# EAGLE board Resistor_Resistor (EAGLE 8.3.0), part 23 of 32
## Placement (x,y rotation side) (continued)
R27970  10K  [0201]  194.82,104.29 0 top
R27971  10K  [0201]  194.82,104.9 0 top
R27972  10K  [0201]  194.82,105.51 0 top
R27973  10K  [0201]  194.82,106.12 0 top
R27974  10K  [0201]  194.82,106.73 0 top
R27975  10K  [0201]  194.82,107.34 0 top
R27976  10K  [0201]  194.82,107.95 0 top
R27977  10K  [0201]  194.82,108.56 0 top
R27978  10K  [0201]  194.82,109.17 0 top
R27979  10K  [0201]  194.82,109.78 0 top
R27980  10K  [0201]  194.82,110.39 0 top
R27981  10K  [0201]  194.82,111 0 top
R27982  10K  [0201]  194.82,111.61 0 top
R27983  10K  [0201]  194.82,112.22 0 top
R27984  10K  [0201]  194.82,112.83 0 top
R27985  10K  [0201]  194.82,113.44 0 top
R27986  10K  [0201]  194.82,114.05 0 top
R27987  10K  [0201]  194.82,114.66 0 top
R27988  10K  [0201]  194.82,115.27 0 top
R27989  10K  [0201]  194.82,115.87 0 top
R27990  10K  [0201]  194.82,116.48 0 top
R27991  10K  [0201]  194.82,117.09 0 top
R27992  10K  [0201]  194.82,117.7 0 top
R27993  10K  [0201]  194.82,118.31 0 top
R27994  10K  [0201]  194.82,118.92 0 top
R27995  10K  [0201]  194.82,119.53 0 top
R27996  10K  [0201]  194.82,120.14 0 top
R27997  10K  [0201]  194.82,120.75 0 top
R27998  10K  [0201]  194.82,121.36 0 top
R27999  10K  [0201]  194.82,121.97 0 top
R28000  10K  [0201]  194.82,122.58 0 top
R28001  10K  [0201]  196.04,1.27 0 top
R28002  10K  [0201]  196.04,1.88 0 top
R28003  10K  [0201]  196.04,2.49 0 top
R28004  10K  [0201]  196.04,3.1 0 top
R28005  10K  [0201]  196.04,3.71 0 top
R28006  10K  [0201]  196.04,4.32 0 top
R28007  10K  [0201]  196.04,4.93 0 top
R28008  10K  [0201]  196.04,5.54 0 top
R28009  10K  [0201]  196.04,6.15 0 top
R28010  10K  [0201]  196.04,6.76 0 top
R28011  10K  [0201]  196.04,7.37 0 top
R28012  10K  [0201]  196.04,7.98 0 top
R28013  10K  [0201]  196.04,8.59 0 top
R28014  10K  [0201]  196.04,9.19 0 top
R28015  10K  [0201]  196.04,9.8 0 top
R28016  10K  [0201]  196.04,10.41 0 top
R28017  10K  [0201]  196.04,11.02 0 top
R28018  10K  [0201]  196.04,11.63 0 top
R28019  10K  [0201]  196.04,12.24 0 top
R28020  10K  [0201]  196.04,12.85 0 top
R28021  10K  [0201]  196.04,13.46 0 top
R28022  10K  [0201]  196.04,14.07 0 top
R28023  10K  [0201]  196.04,14.68 0 top
R28024  10K  [0201]  196.04,15.29 0 top
R28025  10K  [0201]  196.04,15.9 0 top
R28026  10K  [0201]  196.04,16.51 0 top
R28027  10K  [0201]  196.04,17.12 0 top
R28028  10K  [0201]  196.04,17.73 0 top
R28029  10K  [0201]  196.04,18.34 0 top
R28030  10K  [0201]  196.04,18.95 0 top
R28031  10K  [0201]  196.04,19.56 0 top
R28032  10K  [0201]  196.04,20.17 0 top
R28033  10K  [0201]  196.04,20.78 0 top
R28034  10K  [0201]  196.04,21.39 0 top
R28035  10K  [0201]  196.04,22 0 top
R28036  10K  [0201]  196.04,22.61 0 top
R28037  10K  [0201]  196.04,23.22 0 top
R28038  10K  [0201]  196.04,23.83 0 top
R28039  10K  [0201]  196.04,24.43 0 top
R28040  10K  [0201]  196.04,25.04 0 top
R28041  10K  [0201]  196.04,25.65 0 top
R28042  10K  [0201]  196.04,26.26 0 top
R28043  10K  [0201]  196.04,26.87 0 top
R28044  10K  [0201]  196.04,27.48 0 top
R28045  10K  [0201]  196.04,28.09 0 top
R28046  10K  [0201]  196.04,28.7 0 top
R28047  10K  [0201]  196.04,29.31 0 top
R28048  10K  [0201]  196.04,29.92 0 top
R28049  10K  [0201]  196.04,30.53 0 top
R28050  10K  [0201]  196.04,31.14 0 top
R28051  10K  [0201]  196.04,31.75 0 top
R28052  10K  [0201]  196.04,32.36 0 top
R28053  10K  [0201]  196.04,32.97 0 top
R28054  10K  [0201]  196.04,33.58 0 top
R28055  10K  [0201]  196.04,34.19 0 top
R28056  10K  [0201]  196.04,34.8 0 top
R28057  10K  [0201]  196.04,35.41 0 top
R28058  10K  [0201]  196.04,36.02 0 top
R28059  10K  [0201]  196.04,36.63 0 top
R28060  10K  [0201]  196.04,37.24 0 top
R28061  10K  [0201]  196.04,37.85 0 top
R28062  10K  [0201]  196.04,38.46 0 top
R28063  10K  [0201]  196.04,39.07 0 top
R28064  10K  [0201]  196.04,39.67 0 top
R28065  10K  [0201]  196.04,40.28 0 top
R28066  10K  [0201]  196.04,40.89 0 top
R28067  10K  [0201]  196.04,41.5 0 top
R28068  10K  [0201]  196.04,42.11 0 top
R28069  10K  [0201]  196.04,42.72 0 top
R28070  10K  [0201]  196.04,43.33 0 top
R28071  10K  [0201]  196.04,43.94 0 top
R28072  10K  [0201]  196.04,44.55 0 top
R28073  10K  [0201]  196.04,45.16 0 top
R28074  10K  [0201]  196.04,45.77 0 top
R28075  10K  [0201]  196.04,46.38 0 top
R28076  10K  [0201]  196.04,46.99 0 top
R28077  10K  [0201]  196.04,47.6 0 top
R28078  10K  [0201]  196.04,48.21 0 top
R28079  10K  [0201]  196.04,48.82 0 top
R28080  10K  [0201]  196.04,49.43 0 top
R28081  10K  [0201]  196.04,50.04 0 top
R28082  10K  [0201]  196.04,50.65 0 top
R28083  10K  [0201]  196.04,51.26 0 top
R28084  10K  [0201]  196.04,51.87 0 top
R28085  10K  [0201]  196.04,52.48 0 top
R28086  10K  [0201]  196.04,53.09 0 top
R28087  10K  [0201]  196.04,53.7 0 top
R28088  10K  [0201]  196.04,54.31 0 top
R28089  10K  [0201]  196.04,54.91 0 top
R28090  10K  [0201]  196.04,55.52 0 top
R28091  10K  [0201]  196.04,56.13 0 top
R28092  10K  [0201]  196.04,56.74 0 top
R28093  10K  [0201]  196.04,57.35 0 top
R28094  10K  [0201]  196.04,57.96 0 top
R28095  10K  [0201]  196.04,58.57 0 top
R28096  10K  [0201]  196.04,59.18 0 top
R28097  10K  [0201]  196.04,59.79 0 top
R28098  10K  [0201]  196.04,60.4 0 top
R28099  10K  [0201]  196.04,61.01 0 top
R28100  10K  [0201]  196.04,61.62 0 top
R28101  10K  [0201]  196.04,62.23 0 top
R28102  10K  [0201]  196.04,62.84 0 top
R28103  10K  [0201]  196.04,63.45 0 top
R28104  10K  [0201]  196.04,64.06 0 top
R28105  10K  [0201]  196.04,64.67 0 top
R28106  10K  [0201]  196.04,65.28 0 top
R28107  10K  [0201]  196.04,65.89 0 top
R28108  10K  [0201]  196.04,66.5 0 top
R28109  10K  [0201]  196.04,67.11 0 top
R28110  10K  [0201]  196.04,67.72 0 top
R28111  10K  [0201]  196.04,68.33 0 top
R28112  10K  [0201]  196.04,68.94 0 top
R28113  10K  [0201]  196.04,69.55 0 top
R28114  10K  [0201]  196.04,70.15 0 top
R28115  10K  [0201]  196.04,70.76 0 top
R28116  10K  [0201]  196.04,71.37 0 top
R28117  10K  [0201]  196.04,71.98 0 top
R28118  10K  [0201]  196.04,72.59 0 top
R28119  10K  [0201]  196.04,73.2 0 top
R28120  10K  [0201]  196.04,73.81 0 top
R28121  10K  [0201]  196.04,74.42 0 top
R28122  10K  [0201]  196.04,75.03 0 top
R28123  10K  [0201]  196.04,75.64 0 top
R28124  10K  [0201]  196.04,76.25 0 top
R28125  10K  [0201]  196.04,76.86 0 top
R28126  10K  [0201]  196.04,77.47 0 top
R28127  10K  [0201]  196.04,78.08 0 top
R28128  10K  [0201]  196.04,78.69 0 top
R28129  10K  [0201]  196.04,79.3 0 top
R28130  10K  [0201]  196.04,79.91 0 top
R28131  10K  [0201]  196.04,80.52 0 top
R28132  10K  [0201]  196.04,81.13 0 top
R28133  10K  [0201]  196.04,81.74 0 top
R28134  10K  [0201]  196.04,82.35 0 top
R28135  10K  [0201]  196.04,82.96 0 top
R28136  10K  [0201]  196.04,83.57 0 top
R28137  10K  [0201]  196.04,84.18 0 top
R28138  10K  [0201]  196.04,84.79 0 top
R28139  10K  [0201]  196.04,85.39 0 top
R28140  10K  [0201]  196.04,86 0 top
R28141  10K  [0201]  196.04,86.61 0 top
R28142  10K  [0201]  196.04,87.22 0 top
R28143  10K  [0201]  196.04,87.83 0 top
R28144  10K  [0201]  196.04,88.44 0 top
R28145  10K  [0201]  196.04,89.05 0 top
R28146  10K  [0201]  196.04,89.66 0 top
R28147  10K  [0201]  196.04,90.27 0 top
R28148  10K  [0201]  196.04,90.88 0 top
R28149  10K  [0201]  196.04,91.49 0 top
R28150  10K  [0201]  196.04,92.1 0 top
R28151  10K  [0201]  196.04,92.71 0 top
R28152  10K  [0201]  196.04,93.32 0 top
R28153  10K  [0201]  196.04,93.93 0 top
R28154  10K  [0201]  196.04,94.54 0 top
R28155  10K  [0201]  196.04,95.15 0 top
R28156  10K  [0201]  196.04,95.76 0 top
R28157  10K  [0201]  196.04,96.37 0 top
R28158  10K  [0201]  196.04,96.98 0 top
R28159  10K  [0201]  196.04,97.59 0 top
R28160  10K  [0201]  196.04,98.2 0 top
R28161  10K  [0201]  196.04,98.81 0 top
R28162  10K  [0201]  196.04,99.42 0 top
R28163  10K  [0201]  196.04,100.03 0 top
R28164  10K  [0201]  196.04,100.63 0 top
R28165  10K  [0201]  196.04,101.24 0 top
R28166  10K  [0201]  196.04,101.85 0 top
R28167  10K  [0201]  196.04,102.46 0 top
R28168  10K  [0201]  196.04,103.07 0 top
R28169  10K  [0201]  196.04,103.68 0 top
R28170  10K  [0201]  196.04,104.29 0 top
R28171  10K  [0201]  196.04,104.9 0 top
R28172  10K  [0201]  196.04,105.51 0 top
R28173  10K  [0201]  196.04,106.12 0 top
R28174  10K  [0201]  196.04,106.73 0 top
R28175  10K  [0201]  196.04,107.34 0 top
R28176  10K  [0201]  196.04,107.95 0 top
R28177  10K  [0201]  196.04,108.56 0 top
R28178  10K  [0201]  196.04,109.17 0 top
R28179  10K  [0201]  196.04,109.78 0 top
R28180  10K  [0201]  196.04,110.39 0 top
R28181  10K  [0201]  196.04,111 0 top
R28182  10K  [0201]  196.04,111.61 0 top
R28183  10K  [0201]  196.04,112.22 0 top
R28184  10K  [0201]  196.04,112.83 0 top
R28185  10K  [0201]  196.04,113.44 0 top
R28186  10K  [0201]  196.04,114.05 0 top
R28187  10K  [0201]  196.04,114.66 0 top
R28188  10K  [0201]  196.04,115.27 0 top
R28189  10K  [0201]  196.04,115.87 0 top
R28190  10K  [0201]  196.04,116.48 0 top
R28191  10K  [0201]  196.04,117.09 0 top
R28192  10K  [0201]  196.04,117.7 0 top
R28193  10K  [0201]  196.04,118.31 0 top
R28194  10K  [0201]  196.04,118.92 0 top
R28195  10K  [0201]  196.04,119.53 0 top
R28196  10K  [0201]  196.04,120.14 0 top
R28197  10K  [0201]  196.04,120.75 0 top
R28198  10K  [0201]  196.04,121.36 0 top
R28199  10K  [0201]  196.04,121.97 0 top
R28200  10K  [0201]  196.04,122.58 0 top
R28201  10K  [0201]  197.26,1.27 0 top
R28202  10K  [0201]  197.26,1.88 0 top
R28203  10K  [0201]  197.26,2.49 0 top
R28204  10K  [0201]  197.26,3.1 0 top
R28205  10K  [0201]  197.26,3.71 0 top
R28206  10K  [0201]  197.26,4.32 0 top
R28207  10K  [0201]  197.26,4.93 0 top
R28208  10K  [0201]  197.26,5.54 0 top
R28209  10K  [0201]  197.26,6.15 0 top
R28210  10K  [0201]  197.26,6.76 0 top
R28211  10K  [0201]  197.26,7.37 0 top
R28212  10K  [0201]  197.26,7.98 0 top
R28213  10K  [0201]  197.26,8.59 0 top
R28214  10K  [0201]  197.26,9.19 0 top
R28215  10K  [0201]  197.26,9.8 0 top
R28216  10K  [0201]  197.26,10.41 0 top
R28217  10K  [0201]  197.26,11.02 0 top
R28218  10K  [0201]  197.26,11.63 0 top
R28219  10K  [0201]  197.26,12.24 0 top
R28220  10K  [0201]  197.26,12.85 0 top
R28221  10K  [0201]  197.26,13.46 0 top
R28222  10K  [0201]  197.26,14.07 0 top
R28223  10K  [0201]  197.26,14.68 0 top
R28224  10K  [0201]  197.26,15.29 0 top
R28225  10K  [0201]  197.26,15.9 0 top
R28226  10K  [0201]  197.26,16.51 0 top
R28227  10K  [0201]  197.26,17.12 0 top
R28228  10K  [0201]  197.26,17.73 0 top
R28229  10K  [0201]  197.26,18.34 0 top
R28230  10K  [0201]  197.26,18.95 0 top
R28231  10K  [0201]  197.26,19.56 0 top
R28232  10K  [0201]  197.26,20.17 0 top
R28233  10K  [0201]  197.26,20.78 0 top
R28234  10K  [0201]  197.26,21.39 0 top
R28235  10K  [0201]  197.26,22 0 top
R28236  10K  [0201]  197.26,22.61 0 top
R28237  10K  [0201]  197.26,23.22 0 top
R28238  10K  [0201]  197.26,23.83 0 top
R28239  10K  [0201]  197.26,24.43 0 top
R28240  10K  [0201]  197.26,25.04 0 top
R28241  10K  [0201]  197.26,25.65 0 top
R28242  10K  [0201]  197.26,26.26 0 top
R28243  10K  [0201]  197.26,26.87 0 top
R28244  10K  [0201]  197.26,27.48 0 top
R28245  10K  [0201]  197.26,28.09 0 top
R28246  10K  [0201]  197.26,28.7 0 top
R28247  10K  [0201]  197.26,29.31 0 top
R28248  10K  [0201]  197.26,29.92 0 top
R28249  10K  [0201]  197.26,30.53 0 top
R28250  10K  [0201]  197.26,31.14 0 top
R28251  10K  [0201]  197.26,31.75 0 top
R28252  10K  [0201]  197.26,32.36 0 top
R28253  10K  [0201]  197.26,32.97 0 top
R28254  10K  [0201]  197.26,33.58 0 top
R28255  10K  [0201]  197.26,34.19 0 top
R28256  10K  [0201]  197.26,34.8 0 top
R28257  10K  [0201]  197.26,35.41 0 top
R28258  10K  [0201]  197.26,36.02 0 top
R28259  10K  [0201]  197.26,36.63 0 top
R28260  10K  [0201]  197.26,37.24 0 top
R28261  10K  [0201]  197.26,37.85 0 top
R28262  10K  [0201]  197.26,38.46 0 top
R28263  10K  [0201]  197.26,39.07 0 top
R28264  10K  [0201]  197.26,39.67 0 top
R28265  10K  [0201]  197.26,40.28 0 top
R28266  10K  [0201]  197.26,40.89 0 top
R28267  10K  [0201]  197.26,41.5 0 top
R28268  10K  [0201]  197.26,42.11 0 top
R28269  10K  [0201]  197.26,42.72 0 top
R28270  10K  [0201]  197.26,43.33 0 top
R28271  10K  [0201]  197.26,43.94 0 top
R28272  10K  [0201]  197.26,44.55 0 top
R28273  10K  [0201]  197.26,45.16 0 top
R28274  10K  [0201]  197.26,45.77 0 top
R28275  10K  [0201]  197.26,46.38 0 top
R28276  10K  [0201]  197.26,46.99 0 top
R28277  10K  [0201]  197.26,47.6 0 top
R28278  10K  [0201]  197.26,48.21 0 top
R28279  10K  [0201]  197.26,48.82 0 top
R28280  10K  [0201]  197.26,49.43 0 top
R28281  10K  [0201]  197.26,50.04 0 top
R28282  10K  [0201]  197.26,50.65 0 top
R28283  10K  [0201]  197.26,51.26 0 top
R28284  10K  [0201]  197.26,51.87 0 top
R28285  10K  [0201]  197.26,52.48 0 top
R28286  10K  [0201]  197.26,53.09 0 top
R28287  10K  [0201]  197.26,53.7 0 top
R28288  10K  [0201]  197.26,54.31 0 top
R28289  10K  [0201]  197.26,54.91 0 top
R28290  10K  [0201]  197.26,55.52 0 top
R28291  10K  [0201]  197.26,56.13 0 top
R28292  10K  [0201]  197.26,56.74 0 top
R28293  10K  [0201]  197.26,57.35 0 top
R28294  10K  [0201]  197.26,57.96 0 top
R28295  10K  [0201]  197.26,58.57 0 top
R28296  10K  [0201]  197.26,59.18 0 top
R28297  10K  [0201]  197.26,59.79 0 top
R28298  10K  [0201]  197.26,60.4 0 top
R28299  10K  [0201]  197.26,61.01 0 top
R28300  10K  [0201]  197.26,61.62 0 top
R28301  10K  [0201]  197.26,62.23 0 top
R28302  10K  [0201]  197.26,62.84 0 top
R28303  10K  [0201]  197.26,63.45 0 top
R28304  10K  [0201]  197.26,64.06 0 top
R28305  10K  [0201]  197.26,64.67 0 top
R28306  10K  [0201]  197.26,65.28 0 top
R28307  10K  [0201]  197.26,65.89 0 top
R28308  10K  [0201]  197.26,66.5 0 top
R28309  10K  [0201]  197.26,67.11 0 top
R28310  10K  [0201]  197.26,67.72 0 top
R28311  10K  [0201]  197.26,68.33 0 top
R28312  10K  [0201]  197.26,68.94 0 top
R28313  10K  [0201]  197.26,69.55 0 top
R28314  10K  [0201]  197.26,70.15 0 top
R28315  10K  [0201]  197.26,70.76 0 top
R28316  10K  [0201]  197.26,71.37 0 top
R28317  10K  [0201]  197.26,71.98 0 top
R28318  10K  [0201]  197.26,72.59 0 top
R28319  10K  [0201]  197.26,73.2 0 top
R28320  10K  [0201]  197.26,73.81 0 top
R28321  10K  [0201]  197.26,74.42 0 top
R28322  10K  [0201]  197.26,75.03 0 top
R28323  10K  [0201]  197.26,75.64 0 top
R28324  10K  [0201]  197.26,76.25 0 top
R28325  10K  [0201]  197.26,76.86 0 top
R28326  10K  [0201]  197.26,77.47 0 top
R28327  10K  [0201]  197.26,78.08 0 top
R28328  10K  [0201]  197.26,78.69 0 top
R28329  10K  [0201]  197.26,79.3 0 top
R28330  10K  [0201]  197.26,79.91 0 top
R28331  10K  [0201]  197.26,80.52 0 top
R28332  10K  [0201]  197.26,81.13 0 top
R28333  10K  [0201]  197.26,81.74 0 top
R28334  10K  [0201]  197.26,82.35 0 top
R28335  10K  [0201]  197.26,82.96 0 top
R28336  10K  [0201]  197.26,83.57 0 top
R28337  10K  [0201]  197.26,84.18 0 top
R28338  10K  [0201]  197.26,84.79 0 top
R28339  10K  [0201]  197.26,85.39 0 top
R28340  10K  [0201]  197.26,86 0 top
R28341  10K  [0201]  197.26,86.61 0 top
R28342  10K  [0201]  197.26,87.22 0 top
R28343  10K  [0201]  197.26,87.83 0 top
R28344  10K  [0201]  197.26,88.44 0 top
R28345  10K  [0201]  197.26,89.05 0 top
R28346  10K  [0201]  197.26,89.66 0 top
R28347  10K  [0201]  197.26,90.27 0 top
R28348  10K  [0201]  197.26,90.88 0 top
R28349  10K  [0201]  197.26,91.49 0 top
R28350  10K  [0201]  197.26,92.1 0 top
R28351  10K  [0201]  197.26,92.71 0 top
R28352  10K  [0201]  197.26,93.32 0 top
R28353  10K  [0201]  197.26,93.93 0 top
R28354  10K  [0201]  197.26,94.54 0 top
R28355  10K  [0201]  197.26,95.15 0 top
R28356  10K  [0201]  197.26,95.76 0 top
R28357  10K  [0201]  197.26,96.37 0 top
R28358  10K  [0201]  197.26,96.98 0 top
R28359  10K  [0201]  197.26,97.59 0 top
R28360  10K  [0201]  197.26,98.2 0 top
R28361  10K  [0201]  197.26,98.81 0 top
R28362  10K  [0201]  197.26,99.42 0 top
R28363  10K  [0201]  197.26,100.03 0 top
R28364  10K  [0201]  197.26,100.63 0 top
R28365  10K  [0201]  197.26,101.24 0 top
R28366  10K  [0201]  197.26,101.85 0 top
R28367  10K  [0201]  197.26,102.46 0 top
R28368  10K  [0201]  197.26,103.07 0 top
R28369  10K  [0201]  197.26,103.68 0 top
R28370  10K  [0201]  197.26,104.29 0 top
R28371  10K  [0201]  197.26,104.9 0 top
R28372  10K  [0201]  197.26,105.51 0 top
R28373  10K  [0201]  197.26,106.12 0 top
R28374  10K  [0201]  197.26,106.73 0 top
R28375  10K  [0201]  197.26,107.34 0 top
R28376  10K  [0201]  197.26,107.95 0 top
R28377  10K  [0201]  197.26,108.56 0 top
R28378  10K  [0201]  197.26,109.17 0 top
R28379  10K  [0201]  197.26,109.78 0 top
R28380  10K  [0201]  197.26,110.39 0 top
R28381  10K  [0201]  197.26,111 0 top
R28382  10K  [0201]  197.26,111.61 0 top
R28383  10K  [0201]  197.26,112.22 0 top
R28384  10K  [0201]  197.26,112.83 0 top
R28385  10K  [0201]  197.26,113.44 0 top
R28386  10K  [0201]  197.26,114.05 0 top
R28387  10K  [0201]  197.26,114.66 0 top
R28388  10K  [0201]  197.26,115.27 0 top
R28389  10K  [0201]  197.26,115.87 0 top
R28390  10K  [0201]  197.26,116.48 0 top
R28391  10K  [0201]  197.26,117.09 0 top
R28392  10K  [0201]  197.26,117.7 0 top
R28393  10K  [0201]  197.26,118.31 0 top
R28394  10K  [0201]  197.26,118.92 0 top
R28395  10K  [0201]  197.26,119.53 0 top
R28396  10K  [0201]  197.26,120.14 0 top
R28397  10K  [0201]  197.26,120.75 0 top
R28398  10K  [0201]  197.26,121.36 0 top
R28399  10K  [0201]  197.26,121.97 0 top
R28400  10K  [0201]  197.26,122.58 0 top
R28401  10K  [0201]  198.48,1.27 0 top
R28402  10K  [0201]  198.48,1.88 0 top
R28403  10K  [0201]  198.48,2.49 0 top
R28404  10K  [0201]  198.48,3.1 0 top
R28405  10K  [0201]  198.48,3.71 0 top
R28406  10K  [0201]  198.48,4.32 0 top
R28407  10K  [0201]  198.48,4.93 0 top
R28408  10K  [0201]  198.48,5.54 0 top
R28409  10K  [0201]  198.48,6.15 0 top
R28410  10K  [0201]  198.48,6.76 0 top
R28411  10K  [0201]  198.48,7.37 0 top
R28412  10K  [0201]  198.48,7.98 0 top
R28413  10K  [0201]  198.48,8.59 0 top
R28414  10K  [0201]  198.48,9.19 0 top
R28415  10K  [0201]  198.48,9.8 0 top
R28416  10K  [0201]  198.48,10.41 0 top
R28417  10K  [0201]  198.48,11.02 0 top
R28418  10K  [0201]  198.48,11.63 0 top
R28419  10K  [0201]  198.48,12.24 0 top
R28420  10K  [0201]  198.48,12.85 0 top
R28421  10K  [0201]  198.48,13.46 0 top
R28422  10K  [0201]  198.48,14.07 0 top
R28423  10K  [0201]  198.48,14.68 0 top
R28424  10K  [0201]  198.48,15.29 0 top
R28425  10K  [0201]  198.48,15.9 0 top
R28426  10K  [0201]  198.48,16.51 0 top
R28427  10K  [0201]  198.48,17.12 0 top
R28428  10K  [0201]  198.48,17.73 0 top
R28429  10K  [0201]  198.48,18.34 0 top
R28430  10K  [0201]  198.48,18.95 0 top
R28431  10K  [0201]  198.48,19.56 0 top
R28432  10K  [0201]  198.48,20.17 0 top
R28433  10K  [0201]  198.48,20.78 0 top
R28434  10K  [0201]  198.48,21.39 0 top
R28435  10K  [0201]  198.48,22 0 top
R28436  10K  [0201]  198.48,22.61 0 top
R28437  10K  [0201]  198.48,23.22 0 top
R28438  10K  [0201]  198.48,23.83 0 top
R28439  10K  [0201]  198.48,24.43 0 top
R28440  10K  [0201]  198.48,25.04 0 top
R28441  10K  [0201]  198.48,25.65 0 top
R28442  10K  [0201]  198.48,26.26 0 top
R28443  10K  [0201]  198.48,26.87 0 top
R28444  10K  [0201]  198.48,27.48 0 top
R28445  10K  [0201]  198.48,28.09 0 top
R28446  10K  [0201]  198.48,28.7 0 top
R28447  10K  [0201]  198.48,29.31 0 top
R28448  10K  [0201]  198.48,29.92 0 top
R28449  10K  [0201]  198.48,30.53 0 top
R28450  10K  [0201]  198.48,31.14 0 top
R28451  10K  [0201]  198.48,31.75 0 top
R28452  10K  [0201]  198.48,32.36 0 top
R28453  10K  [0201]  198.48,32.97 0 top
R28454  10K  [0201]  198.48,33.58 0 top
R28455  10K  [0201]  198.48,34.19 0 top
R28456  10K  [0201]  198.48,34.8 0 top
R28457  10K  [0201]  198.48,35.41 0 top
R28458  10K  [0201]  198.48,36.02 0 top
R28459  10K  [0201]  198.48,36.63 0 top
R28460  10K  [0201]  198.48,37.24 0 top
R28461  10K  [0201]  198.48,37.85 0 top
R28462  10K  [0201]  198.48,38.46 0 top
R28463  10K  [0201]  198.48,39.07 0 top
R28464  10K  [0201]  198.48,39.67 0 top
R28465  10K  [0201]  198.48,40.28 0 top
R28466  10K  [0201]  198.48,40.89 0 top
R28467  10K  [0201]  198.48,41.5 0 top
R28468  10K  [0201]  198.48,42.11 0 top
R28469  10K  [0201]  198.48,42.72 0 top
R28470  10K  [0201]  198.48,43.33 0 top
R28471  10K  [0201]  198.48,43.94 0 top
R28472  10K  [0201]  198.48,44.55 0 top
R28473  10K  [0201]  198.48,45.16 0 top
R28474  10K  [0201]  198.48,45.77 0 top
R28475  10K  [0201]  198.48,46.38 0 top
R28476  10K  [0201]  198.48,46.99 0 top
R28477  10K  [0201]  198.48,47.6 0 top
R28478  10K  [0201]  198.48,48.21 0 top
R28479  10K  [0201]  198.48,48.82 0 top
R28480  10K  [0201]  198.48,49.43 0 top
R28481  10K  [0201]  198.48,50.04 0 top
R28482  10K  [0201]  198.48,50.65 0 top
R28483  10K  [0201]  198.48,51.26 0 top
R28484  10K  [0201]  198.48,51.87 0 top
R28485  10K  [0201]  198.48,52.48 0 top
R28486  10K  [0201]  198.48,53.09 0 top
R28487  10K  [0201]  198.48,53.7 0 top
R28488  10K  [0201]  198.48,54.31 0 top
R28489  10K  [0201]  198.48,54.91 0 top
R28490  10K  [0201]  198.48,55.52 0 top
R28491  10K  [0201]  198.48,56.13 0 top
R28492  10K  [0201]  198.48,56.74 0 top
R28493  10K  [0201]  198.48,57.35 0 top
R28494  10K  [0201]  198.48,57.96 0 top
R28495  10K  [0201]  198.48,58.57 0 top
R28496  10K  [0201]  198.48,59.18 0 top
R28497  10K  [0201]  198.48,59.79 0 top
R28498  10K  [0201]  198.48,60.4 0 top
R28499  10K  [0201]  198.48,61.01 0 top
R28500  10K  [0201]  198.48,61.62 0 top
R28501  10K  [0201]  198.48,62.23 0 top
R28502  10K  [0201]  198.48,62.84 0 top
R28503  10K  [0201]  198.48,63.45 0 top
R28504  10K  [0201]  198.48,64.06 0 top
R28505  10K  [0201]  198.48,64.67 0 top
R28506  10K  [0201]  198.48,65.28 0 top
R28507  10K  [0201]  198.48,65.89 0 top
R28508  10K  [0201]  198.48,66.5 0 top
R28509  10K  [0201]  198.48,67.11 0 top
R28510  10K  [0201]  198.48,67.72 0 top
R28511  10K  [0201]  198.48,68.33 0 top
R28512  10K  [0201]  198.48,68.94 0 top
R28513  10K  [0201]  198.48,69.55 0 top
R28514  10K  [0201]  198.48,70.15 0 top
R28515  10K  [0201]  198.48,70.76 0 top
R28516  10K  [0201]  198.48,71.37 0 top
R28517  10K  [0201]  198.48,71.98 0 top
R28518  10K  [0201]  198.48,72.59 0 top
R28519  10K  [0201]  198.48,73.2 0 top
R28520  10K  [0201]  198.48,73.81 0 top
R28521  10K  [0201]  198.48,74.42 0 top
R28522  10K  [0201]  198.48,75.03 0 top
R28523  10K  [0201]  198.48,75.64 0 top
R28524  10K  [0201]  198.48,76.25 0 top
R28525  10K  [0201]  198.48,76.86 0 top
R28526  10K  [0201]  198.48,77.47 0 top
R28527  10K  [0201]  198.48,78.08 0 top
R28528  10K  [0201]  198.48,78.69 0 top
R28529  10K  [0201]  198.48,79.3 0 top
R28530  10K  [0201]  198.48,79.91 0 top
R28531  10K  [0201]  198.48,80.52 0 top
R28532  10K  [0201]  198.48,81.13 0 top
R28533  10K  [0201]  198.48,81.74 0 top
R28534  10K  [0201]  198.48,82.35 0 top
R28535  10K  [0201]  198.48,82.96 0 top
R28536  10K  [0201]  198.48,83.57 0 top
R28537  10K  [0201]  198.48,84.18 0 top
R28538  10K  [0201]  198.48,84.79 0 top
R28539  10K  [0201]  198.48,85.39 0 top
R28540  10K  [0201]  198.48,86 0 top
R28541  10K  [0201]  198.48,86.61 0 top
R28542  10K  [0201]  198.48,87.22 0 top
R28543  10K  [0201]  198.48,87.83 0 top
R28544  10K  [0201]  198.48,88.44 0 top
R28545  10K  [0201]  198.48,89.05 0 top
R28546  10K  [0201]  198.48,89.66 0 top
R28547  10K  [0201]  198.48,90.27 0 top
R28548  10K  [0201]  198.48,90.88 0 top
R28549  10K  [0201]  198.48,91.49 0 top
R28550  10K  [0201]  198.48,92.1 0 top
R28551  10K  [0201]  198.48,92.71 0 top
R28552  10K  [0201]  198.48,93.32 0 top
R28553  10K  [0201]  198.48,93.93 0 top
R28554  10K  [0201]  198.48,94.54 0 top
R28555  10K  [0201]  198.48,95.15 0 top
R28556  10K  [0201]  198.48,95.76 0 top
R28557  10K  [0201]  198.48,96.37 0 top
R28558  10K  [0201]  198.48,96.98 0 top
R28559  10K  [0201]  198.48,97.59 0 top
R28560  10K  [0201]  198.48,98.2 0 top
R28561  10K  [0201]  198.48,98.81 0 top
R28562  10K  [0201]  198.48,99.42 0 top
R28563  10K  [0201]  198.48,100.03 0 top
R28564  10K  [0201]  198.48,100.63 0 top
R28565  10K  [0201]  198.48,101.24 0 top
R28566  10K  [0201]  198.48,101.85 0 top
R28567  10K  [0201]  198.48,102.46 0 top
R28568  10K  [0201]  198.48,103.07 0 top
R28569  10K  [0201]  198.48,103.68 0 top
R28570  10K  [0201]  198.48,104.29 0 top
R28571  10K  [0201]  198.48,104.9 0 top
R28572  10K  [0201]  198.48,105.51 0 top
R28573  10K  [0201]  198.48,106.12 0 top
R28574  10K  [0201]  198.48,106.73 0 top
R28575  10K  [0201]  198.48,107.34 0 top
R28576  10K  [0201]  198.48,107.95 0 top
R28577  10K  [0201]  198.48,108.56 0 top
R28578  10K  [0201]  198.48,109.17 0 top
R28579  10K  [0201]  198.48,109.78 0 top
R28580  10K  [0201]  198.48,110.39 0 top
R28581  10K  [0201]  198.48,111 0 top
R28582  10K  [0201]  198.48,111.61 0 top
R28583  10K  [0201]  198.48,112.22 0 top
R28584  10K  [0201]  198.48,112.83 0 top
R28585  10K  [0201]  198.48,113.44 0 top
R28586  10K  [0201]  198.48,114.05 0 top
R28587  10K  [0201]  198.48,114.66 0 top
R28588  10K  [0201]  198.48,115.27 0 top
R28589  10K  [0201]  198.48,115.87 0 top
R28590  10K  [0201]  198.48,116.48 0 top
R28591  10K  [0201]  198.48,117.09 0 top
R28592  10K  [0201]  198.48,117.7 0 top
R28593  10K  [0201]  198.48,118.31 0 top
R28594  10K  [0201]  198.48,118.92 0 top
R28595  10K  [0201]  198.48,119.53 0 top
R28596  10K  [0201]  198.48,120.14 0 top
R28597  10K  [0201]  198.48,120.75 0 top
R28598  10K  [0201]  198.48,121.36 0 top
R28599  10K  [0201]  198.48,121.97 0 top
R28600  10K  [0201]  198.48,122.58 0 top
R28601  10K  [0201]  199.69,1.27 0 top
R28602  10K  [0201]  199.69,1.88 0 top
R28603  10K  [0201]  199.69,2.49 0 top
R28604  10K  [0201]  199.69,3.1 0 top
R28605  10K  [0201]  199.69,3.71 0 top
R28606  10K  [0201]  199.69,4.32 0 top
R28607  10K  [0201]  199.69,4.93 0 top
R28608  10K  [0201]  199.69,5.54 0 top
R28609  10K  [0201]  199.69,6.15 0 top
R28610  10K  [0201]  199.69,6.76 0 top
R28611  10K  [0201]  199.69,7.37 0 top
R28612  10K  [0201]  199.69,7.98 0 top
R28613  10K  [0201]  199.69,8.59 0 top
R28614  10K  [0201]  199.69,9.19 0 top
R28615  10K  [0201]  199.69,9.8 0 top
R28616  10K  [0201]  199.69,10.41 0 top
R28617  10K  [0201]  199.69,11.02 0 top
R28618  10K  [0201]  199.69,11.63 0 top
R28619  10K  [0201]  199.69,12.24 0 top
R28620  10K  [0201]  199.69,12.85 0 top
R28621  10K  [0201]  199.69,13.46 0 top
R28622  10K  [0201]  199.69,14.07 0 top
R28623  10K  [0201]  199.69,14.68 0 top
R28624  10K  [0201]  199.69,15.29 0 top
R28625  10K  [0201]  199.69,15.9 0 top
R28626  10K  [0201]  199.69,16.51 0 top
R28627  10K  [0201]  199.69,17.12 0 top
R28628  10K  [0201]  199.69,17.73 0 top
R28629  10K  [0201]  199.69,18.34 0 top
R28630  10K  [0201]  199.69,18.95 0 top
R28631  10K  [0201]  199.69,19.56 0 top
R28632  10K  [0201]  199.69,20.17 0 top
R28633  10K  [0201]  199.69,20.78 0 top
R28634  10K  [0201]  199.69,21.39 0 top
R28635  10K  [0201]  199.69,22 0 top
R28636  10K  [0201]  199.69,22.61 0 top
R28637  10K  [0201]  199.69,23.22 0 top
R28638  10K  [0201]  199.69,23.83 0 top
R28639  10K  [0201]  199.69,24.43 0 top
R28640  10K  [0201]  199.69,25.04 0 top
R28641  10K  [0201]  199.69,25.65 0 top
R28642  10K  [0201]  199.69,26.26 0 top
R28643  10K  [0201]  199.69,26.87 0 top
R28644  10K  [0201]  199.69,27.48 0 top
R28645  10K  [0201]  199.69,28.09 0 top
R28646  10K  [0201]  199.69,28.7 0 top
R28647  10K  [0201]  199.69,29.31 0 top
R28648  10K  [0201]  199.69,29.92 0 top
R28649  10K  [0201]  199.69,30.53 0 top
R28650  10K  [0201]  199.69,31.14 0 top
R28651  10K  [0201]  199.69,31.75 0 top
R28652  10K  [0201]  199.69,32.36 0 top
R28653  10K  [0201]  199.69,32.97 0 top
R28654  10K  [0201]  199.69,33.58 0 top
R28655  10K  [0201]  199.69,34.19 0 top
R28656  10K  [0201]  199.69,34.8 0 top
R28657  10K  [0201]  199.69,35.41 0 top
R28658  10K  [0201]  199.69,36.02 0 top
R28659  10K  [0201]  199.69,36.63 0 top
R28660  10K  [0201]  199.69,37.24 0 top
R28661  10K  [0201]  199.69,37.85 0 top
R28662  10K  [0201]  199.69,38.46 0 top
R28663  10K  [0201]  199.69,39.07 0 top
R28664  10K  [0201]  199.69,39.67 0 top
R28665  10K  [0201]  199.69,40.28 0 top
R28666  10K  [0201]  199.69,40.89 0 top
R28667  10K  [0201]  199.69,41.5 0 top
R28668  10K  [0201]  199.69,42.11 0 top
R28669  10K  [0201]  199.69,42.72 0 top
R28670  10K  [0201]  199.69,43.33 0 top
R28671  10K  [0201]  199.69,43.94 0 top
R28672  10K  [0201]  199.69,44.55 0 top
R28673  10K  [0201]  199.69,45.16 0 top
R28674  10K  [0201]  199.69,45.77 0 top
R28675  10K  [0201]  199.69,46.38 0 top
R28676  10K  [0201]  199.69,46.99 0 top
R28677  10K  [0201]  199.69,47.6 0 top
R28678  10K  [0201]  199.69,48.21 0 top
R28679  10K  [0201]  199.69,48.82 0 top
R28680  10K  [0201]  199.69,49.43 0 top
R28681  10K  [0201]  199.69,50.04 0 top
R28682  10K  [0201]  199.69,50.65 0 top
R28683  10K  [0201]  199.69,51.26 0 top
R28684  10K  [0201]  199.69,51.87 0 top
R28685  10K  [0201]  199.69,52.48 0 top
R28686  10K  [0201]  199.69,53.09 0 top
R28687  10K  [0201]  199.69,53.7 0 top
R28688  10K  [0201]  199.69,54.31 0 top
R28689  10K  [0201]  199.69,54.91 0 top
R28690  10K  [0201]  199.69,55.52 0 top
R28691  10K  [0201]  199.69,56.13 0 top
R28692  10K  [0201]  199.69,56.74 0 top
R28693  10K  [0201]  199.69,57.35 0 top
R28694  10K  [0201]  199.69,57.96 0 top
R28695  10K  [0201]  199.69,58.57 0 top
R28696  10K  [0201]  199.69,59.18 0 top
R28697  10K  [0201]  199.69,59.79 0 top
R28698  10K  [0201]  199.69,60.4 0 top
R28699  10K  [0201]  199.69,61.01 0 top
R28700  10K  [0201]  199.69,61.62 0 top
R28701  10K  [0201]  199.69,62.23 0 top
R28702  10K  [0201]  199.69,62.84 0 top
R28703  10K  [0201]  199.69,63.45 0 top
R28704  10K  [0201]  199.69,64.06 0 top
R28705  10K  [0201]  199.69,64.67 0 top
R28706  10K  [0201]  199.69,65.28 0 top
R28707  10K  [0201]  199.69,65.89 0 top
R28708  10K  [0201]  199.69,66.5 0 top
R28709  10K  [0201]  199.69,67.11 0 top
R28710  10K  [0201]  199.69,67.72 0 top
R28711  10K  [0201]  199.69,68.33 0 top
R28712  10K  [0201]  199.69,68.94 0 top
R28713  10K  [0201]  199.69,69.55 0 top
R28714  10K  [0201]  199.69,70.15 0 top
R28715  10K  [0201]  199.69,70.76 0 top
R28716  10K  [0201]  199.69,71.37 0 top
R28717  10K  [0201]  199.69,71.98 0 top
R28718  10K  [0201]  199.69,72.59 0 top
R28719  10K  [0201]  199.69,73.2 0 top
R28720  10K  [0201]  199.69,73.81 0 top
R28721  10K  [0201]  199.69,74.42 0 top
R28722  10K  [0201]  199.69,75.03 0 top
R28723  10K  [0201]  199.69,75.64 0 top
R28724  10K  [0201]  199.69,76.25 0 top
R28725  10K  [0201]  199.69,76.86 0 top
R28726  10K  [0201]  199.69,77.47 0 top
R28727  10K  [0201]  199.69,78.08 0 top
R28728  10K  [0201]  199.69,78.69 0 top
R28729  10K  [0201]  199.69,79.3 0 top
R28730  10K  [0201]  199.69,79.91 0 top
R28731  10K  [0201]  199.69,80.52 0 top
R28732  10K  [0201]  199.69,81.13 0 top
R28733  10K  [0201]  199.69,81.74 0 top
R28734  10K  [0201]  199.69,82.35 0 top
R28735  10K  [0201]  199.69,82.96 0 top
R28736  10K  [0201]  199.69,83.57 0 top
R28737  10K  [0201]  199.69,84.18 0 top
R28738  10K  [0201]  199.69,84.79 0 top
R28739  10K  [0201]  199.69,85.39 0 top
R28740  10K  [0201]  199.69,86 0 top
R28741  10K  [0201]  199.69,86.61 0 top
R28742  10K  [0201]  199.69,87.22 0 top
R28743  10K  [0201]  199.69,87.83 0 top
R28744  10K  [0201]  199.69,88.44 0 top
R28745  10K  [0201]  199.69,89.05 0 top
R28746  10K  [0201]  199.69,89.66 0 top
R28747  10K  [0201]  199.69,90.27 0 top
R28748  10K  [0201]  199.69,90.88 0 top
R28749  10K  [0201]  199.69,91.49 0 top
R28750  10K  [0201]  199.69,92.1 0 top
R28751  10K  [0201]  199.69,92.71 0 top
R28752  10K  [0201]  199.69,93.32 0 top
R28753  10K  [0201]  199.69,93.93 0 top
R28754  10K  [0201]  199.69,94.54 0 top
R28755  10K  [0201]  199.69,95.15 0 top
R28756  10K  [0201]  199.69,95.76 0 top
R28757  10K  [0201]  199.69,96.37 0 top
R28758  10K  [0201]  199.69,96.98 0 top
R28759  10K  [0201]  199.69,97.59 0 top
R28760  10K  [0201]  199.69,98.2 0 top
R28761  10K  [0201]  199.69,98.81 0 top
R28762  10K  [0201]  199.69,99.42 0 top
R28763  10K  [0201]  199.69,100.03 0 top
R28764  10K  [0201]  199.69,100.63 0 top
R28765  10K  [0201]  199.69,101.24 0 top
R28766  10K  [0201]  199.69,101.85 0 top
R28767  10K  [0201]  199.69,102.46 0 top
R28768  10K  [0201]  199.69,103.07 0 top
R28769  10K  [0201]  199.69,103.68 0 top
R28770  10K  [0201]  199.69,104.29 0 top
R28771  10K  [0201]  199.69,104.9 0 top
R28772  10K  [0201]  199.69,105.51 0 top
R28773  10K  [0201]  199.69,106.12 0 top
R28774  10K  [0201]  199.69,106.73 0 top
R28775  10K  [0201]  199.69,107.34 0 top
R28776  10K  [0201]  199.69,107.95 0 top
R28777  10K  [0201]  199.69,108.56 0 top
R28778  10K  [0201]  199.69,109.17 0 top
R28779  10K  [0201]  199.69,109.78 0 top
R28780  10K  [0201]  199.69,110.39 0 top
R28781  10K  [0201]  199.69,111 0 top
R28782  10K  [0201]  199.69,111.61 0 top
R28783  10K  [0201]  199.69,112.22 0 top
R28784  10K  [0201]  199.69,112.83 0 top
R28785  10K  [0201]  199.69,113.44 0 top
R28786  10K  [0201]  199.69,114.05 0 top
R28787  10K  [0201]  199.69,114.66 0 top
R28788  10K  [0201]  199.69,115.27 0 top
R28789  10K  [0201]  199.69,115.87 0 top
R28790  10K  [0201]  199.69,116.48 0 top
R28791  10K  [0201]  199.69,117.09 0 top
R28792  10K  [0201]  199.69,117.7 0 top
R28793  10K  [0201]  199.69,118.31 0 top
R28794  10K  [0201]  199.69,118.92 0 top
R28795  10K  [0201]  199.69,119.53 0 top
R28796  10K  [0201]  199.69,120.14 0 top
R28797  10K  [0201]  199.69,120.75 0 top
R28798  10K  [0201]  199.69,121.36 0 top
R28799  10K  [0201]  199.69,121.97 0 top
R28800  10K  [0201]  199.69,122.58 0 top
R28801  10K  [0201]  200.91,1.27 0 top
R28802  10K  [0201]  200.91,1.88 0 top
R28803  10K  [0201]  200.91,2.49 0 top
R28804  10K  [0201]  200.91,3.1 0 top
R28805  10K  [0201]  200.91,3.71 0 top
R28806  10K  [0201]  200.91,4.32 0 top
R28807  10K  [0201]  200.91,4.93 0 top
R28808  10K  [0201]  200.91,5.54 0 top
R28809  10K  [0201]  200.91,6.15 0 top
R28810  10K  [0201]  200.91,6.76 0 top
R28811  10K  [0201]  200.91,7.37 0 top
R28812  10K  [0201]  200.91,7.98 0 top
R28813  10K  [0201]  200.91,8.59 0 top
R28814  10K  [0201]  200.91,9.19 0 top
R28815  10K  [0201]  200.91,9.8 0 top
R28816  10K  [0201]  200.91,10.41 0 top
R28817  10K  [0201]  200.91,11.02 0 top
R28818  10K  [0201]  200.91,11.63 0 top
R28819  10K  [0201]  200.91,12.24 0 top
R28820  10K  [0201]  200.91,12.85 0 top
R28821  10K  [0201]  200.91,13.46 0 top
R28822  10K  [0201]  200.91,14.07 0 top
R28823  10K  [0201]  200.91,14.68 0 top
R28824  10K  [0201]  200.91,15.29 0 top
R28825  10K  [0201]  200.91,15.9 0 top
R28826  10K  [0201]  200.91,16.51 0 top
R28827  10K  [0201]  200.91,17.12 0 top
R28828  10K  [0201]  200.91,17.73 0 top
R28829  10K  [0201]  200.91,18.34 0 top
R28830  10K  [0201]  200.91,18.95 0 top
R28831  10K  [0201]  200.91,19.56 0 top
R28832  10K  [0201]  200.91,20.17 0 top
R28833  10K  [0201]  200.91,20.78 0 top
R28834  10K  [0201]  200.91,21.39 0 top
R28835  10K  [0201]  200.91,22 0 top
R28836  10K  [0201]  200.91,22.61 0 top
R28837  10K  [0201]  200.91,23.22 0 top
R28838  10K  [0201]  200.91,23.83 0 top
R28839  10K  [0201]  200.91,24.43 0 top
R28840  10K  [0201]  200.91,25.04 0 top
R28841  10K  [0201]  200.91,25.65 0 top
R28842  10K  [0201]  200.91,26.26 0 top
R28843  10K  [0201]  200.91,26.87 0 top
R28844  10K  [0201]  200.91,27.48 0 top
R28845  10K  [0201]  200.91,28.09 0 top
R28846  10K  [0201]  200.91,28.7 0 top
R28847  10K  [0201]  200.91,29.31 0 top
R28848  10K  [0201]  200.91,29.92 0 top
R28849  10K  [0201]  200.91,30.53 0 top
R28850  10K  [0201]  200.91,31.14 0 top
R28851  10K  [0201]  200.91,31.75 0 top
R28852  10K  [0201]  200.91,32.36 0 top
R28853  10K  [0201]  200.91,32.97 0 top
R28854  10K  [0201]  200.91,33.58 0 top
R28855  10K  [0201]  200.91,34.19 0 top
R28856  10K  [0201]  200.91,34.8 0 top
R28857  10K  [0201]  200.91,35.41 0 top
R28858  10K  [0201]  200.91,36.02 0 top
R28859  10K  [0201]  200.91,36.63 0 top
R28860  10K  [0201]  200.91,37.24 0 top
R28861  10K  [0201]  200.91,37.85 0 top
R28862  10K  [0201]  200.91,38.46 0 top
R28863  10K  [0201]  200.91,39.07 0 top
R28864  10K  [0201]  200.91,39.67 0 top
R28865  10K  [0201]  200.91,40.28 0 top
R28866  10K  [0201]  200.91,40.89 0 top
R28867  10K  [0201]  200.91,41.5 0 top
R28868  10K  [0201]  200.91,42.11 0 top
R28869  10K  [0201]  200.91,42.72 0 top
R28870  10K  [0201]  200.91,43.33 0 top
R28871  10K  [0201]  200.91,43.94 0 top
R28872  10K  [0201]  200.91,44.55 0 top
R28873  10K  [0201]  200.91,45.16 0 top
R28874  10K  [0201]  200.91,45.77 0 top
R28875  10K  [0201]  200.91,46.38 0 top
R28876  10K  [0201]  200.91,46.99 0 top
R28877  10K  [0201]  200.91,47.6 0 top
R28878  10K  [0201]  200.91,48.21 0 top
R28879  10K  [0201]  200.91,48.82 0 top
R28880  10K  [0201]  200.91,49.43 0 top
R28881  10K  [0201]  200.91,50.04 0 top
R28882  10K  [0201]  200.91,50.65 0 top
R28883  10K  [0201]  200.91,51.26 0 top
R28884  10K  [0201]  200.91,51.87 0 top
R28885  10K  [0201]  200.91,52.48 0 top
R28886  10K  [0201]  200.91,53.09 0 top
R28887  10K  [0201]  200.91,53.7 0 top
R28888  10K  [0201]  200.91,54.31 0 top
R28889  10K  [0201]  200.91,54.91 0 top
R28890  10K  [0201]  200.91,55.52 0 top
R28891  10K  [0201]  200.91,56.13 0 top
R28892  10K  [0201]  200.91,56.74 0 top
R28893  10K  [0201]  200.91,57.35 0 top
R28894  10K  [0201]  200.91,57.96 0 top
R28895  10K  [0201]  200.91,58.57 0 top
R28896  10K  [0201]  200.91,59.18 0 top
R28897  10K  [0201]  200.91,59.79 0 top
R28898  10K  [0201]  200.91,60.4 0 top
R28899  10K  [0201]  200.91,61.01 0 top
R28900  10K  [0201]  200.91,61.62 0 top
R28901  10K  [0201]  200.91,62.23 0 top
R28902  10K  [0201]  200.91,62.84 0 top
R28903  10K  [0201]  200.91,63.45 0 top
R28904  10K  [0201]  200.91,64.06 0 top
R28905  10K  [0201]  200.91,64.67 0 top
R28906  10K  [0201]  200.91,65.28 0 top
R28907  10K  [0201]  200.91,65.89 0 top
R28908  10K  [0201]  200.91,66.5 0 top
R28909  10K  [0201]  200.91,67.11 0 top
R28910  10K  [0201]  200.91,67.72 0 top
R28911  10K  [0201]  200.91,68.33 0 top
R28912  10K  [0201]  200.91,68.94 0 top
R28913  10K  [0201]  200.91,69.55 0 top
R28914  10K  [0201]  200.91,70.15 0 top
R28915  10K  [0201]  200.91,70.76 0 top
R28916  10K  [0201]  200.91,71.37 0 top
R28917  10K  [0201]  200.91,71.98 0 top
R28918  10K  [0201]  200.91,72.59 0 top
R28919  10K  [0201]  200.91,73.2 0 top
R28920  10K  [0201]  200.91,73.81 0 top
R28921  10K  [0201]  200.91,74.42 0 top
R28922  10K  [0201]  200.91,75.03 0 top
R28923  10K  [0201]  200.91,75.64 0 top
R28924  10K  [0201]  200.91,76.25 0 top
R28925  10K  [0201]  200.91,76.86 0 top
R28926  10K  [0201]  200.91,77.47 0 top
R28927  10K  [0201]  200.91,78.08 0 top
R28928  10K  [0201]  200.91,78.69 0 top
R28929  10K  [0201]  200.91,79.3 0 top
R28930  10K  [0201]  200.91,79.91 0 top
R28931  10K  [0201]  200.91,80.52 0 top
R28932  10K  [0201]  200.91,81.13 0 top
R28933  10K  [0201]  200.91,81.74 0 top
R28934  10K  [0201]  200.91,82.35 0 top
R28935  10K  [0201]  200.91,82.96 0 top
R28936  10K  [0201]  200.91,83.57 0 top
R28937  10K  [0201]  200.91,84.18 0 top
R28938  10K  [0201]  200.91,84.79 0 top
R28939  10K  [0201]  200.91,85.39 0 top
R28940  10K  [0201]  200.91,86 0 top
R28941  10K  [0201]  200.91,86.61 0 top
R28942  10K  [0201]  200.91,87.22 0 top
R28943  10K  [0201]  200.91,87.83 0 top
R28944  10K  [0201]  200.91,88.44 0 top
R28945  10K  [0201]  200.91,89.05 0 top
R28946  10K  [0201]  200.91,89.66 0 top
R28947  10K  [0201]  200.91,90.27 0 top
R28948  10K  [0201]  200.91,90.88 0 top
R28949  10K  [0201]  200.91,91.49 0 top
R28950  10K  [0201]  200.91,92.1 0 top
R28951  10K  [0201]  200.91,92.71 0 top
R28952  10K  [0201]  200.91,93.32 0 top
R28953  10K  [0201]  200.91,93.93 0 top
R28954  10K  [0201]  200.91,94.54 0 top
R28955  10K  [0201]  200.91,95.15 0 top
R28956  10K  [0201]  200.91,95.76 0 top
R28957  10K  [0201]  200.91,96.37 0 top
R28958  10K  [0201]  200.91,96.98 0 top
R28959  10K  [0201]  200.91,97.59 0 top
R28960  10K  [0201]  200.91,98.2 0 top
R28961  10K  [0201]  200.91,98.81 0 top
R28962  10K  [0201]  200.91,99.42 0 top
R28963  10K  [0201]  200.91,100.03 0 top
R28964  10K  [0201]  200.91,100.63 0 top
R28965  10K  [0201]  200.91,101.24 0 top
R28966  10K  [0201]  200.91,101.85 0 top
R28967  10K  [0201]  200.91,102.46 0 top
R28968  10K  [0201]  200.91,103.07 0 top
R28969  10K  [0201]  200.91,103.68 0 top
R28970  10K  [0201]  200.91,104.29 0 top
R28971  10K  [0201]  200.91,104.9 0 top
R28972  10K  [0201]  200.91,105.51 0 top
R28973  10K  [0201]  200.91,106.12 0 top
R28974  10K  [0201]  200.91,106.73 0 top
R28975  10K  [0201]  200.91,107.34 0 top
R28976  10K  [0201]  200.91,107.95 0 top
R28977  10K  [0201]  200.91,108.56 0 top
R28978  10K  [0201]  200.91,109.17 0 top
R28979  10K  [0201]  200.91,109.78 0 top
R28980  10K  [0201]  200.91,110.39 0 top
R28981  10K  [0201]  200.91,111 0 top
R28982  10K  [0201]  200.91,111.61 0 top
R28983  10K  [0201]  200.91,112.22 0 top
R28984  10K  [0201]  200.91,112.83 0 top
R28985  10K  [0201]  200.91,113.44 0 top
R28986  10K  [0201]  200.91,114.05 0 top
R28987  10K  [0201]  200.91,114.66 0 top
R28988  10K  [0201]  200.91,115.27 0 top
R28989  10K  [0201]  200.91,115.87 0 top
R28990  10K  [0201]  200.91,116.48 0 top
R28991  10K  [0201]  200.91,117.09 0 top
R28992  10K  [0201]  200.91,117.7 0 top
R28993  10K  [0201]  200.91,118.31 0 top
R28994  10K  [0201]  200.91,118.92 0 top
R28995  10K  [0201]  200.91,119.53 0 top
R28996  10K  [0201]  200.91,120.14 0 top
R28997  10K  [0201]  200.91,120.75 0 top
R28998  10K  [0201]  200.91,121.36 0 top
R28999  10K  [0201]  200.91,121.97 0 top
R29000  10K  [0201]  200.91,122.58 0 top
R29001  10K  [0201]  202.13,1.27 0 top
R29002  10K  [0201]  202.13,1.88 0 top
R29003  10K  [0201]  202.13,2.49 0 top
R29004  10K  [0201]  202.13,3.1 0 top
R29005  10K  [0201]  202.13,3.71 0 top
R29006  10K  [0201]  202.13,4.32 0 top
R29007  10K  [0201]  202.13,4.93 0 top
R29008  10K  [0201]  202.13,5.54 0 top
R29009  10K  [0201]  202.13,6.15 0 top
R29010  10K  [0201]  202.13,6.76 0 top
R29011  10K  [0201]  202.13,7.37 0 top
R29012  10K  [0201]  202.13,7.98 0 top
R29013  10K  [0201]  202.13,8.59 0 top
R29014  10K  [0201]  202.13,9.19 0 top
R29015  10K  [0201]  202.13,9.8 0 top
R29016  10K  [0201]  202.13,10.41 0 top
R29017  10K  [0201]  202.13,11.02 0 top
R29018  10K  [0201]  202.13,11.63 0 top
R29019  10K  [0201]  202.13,12.24 0 top
R29020  10K  [0201]  202.13,12.85 0 top
R29021  10K  [0201]  202.13,13.46 0 top
R29022  10K  [0201]  202.13,14.07 0 top
R29023  10K  [0201]  202.13,14.68 0 top
R29024  10K  [0201]  202.13,15.29 0 top
R29025  10K  [0201]  202.13,15.9 0 top
R29026  10K  [0201]  202.13,16.51 0 top
R29027  10K  [0201]  202.13,17.12 0 top
R29028  10K  [0201]  202.13,17.73 0 top
R29029  10K  [0201]  202.13,18.34 0 top
R29030  10K  [0201]  202.13,18.95 0 top
R29031  10K  [0201]  202.13,19.56 0 top
R29032  10K  [0201]  202.13,20.17 0 top
R29033  10K  [0201]  202.13,20.78 0 top
R29034  10K  [0201]  202.13,21.39 0 top
R29035  10K  [0201]  202.13,22 0 top
R29036  10K  [0201]  202.13,22.61 0 top
R29037  10K  [0201]  202.13,23.22 0 top
R29038  10K  [0201]  202.13,23.83 0 top
R29039  10K  [0201]  202.13,24.43 0 top
R29040  10K  [0201]  202.13,25.04 0 top
R29041  10K  [0201]  202.13,25.65 0 top
R29042  10K  [0201]  202.13,26.26 0 top
R29043  10K  [0201]  202.13,26.87 0 top
R29044  10K  [0201]  202.13,27.48 0 top
R29045  10K  [0201]  202.13,28.09 0 top
R29046  10K  [0201]  202.13,28.7 0 top
R29047  10K  [0201]  202.13,29.31 0 top
R29048  10K  [0201]  202.13,29.92 0 top
R29049  10K  [0201]  202.13,30.53 0 top
R29050  10K  [0201]  202.13,31.14 0 top
R29051  10K  [0201]  202.13,31.75 0 top
R29052  10K  [0201]  202.13,32.36 0 top
R29053  10K  [0201]  202.13,32.97 0 top
R29054  10K  [0201]  202.13,33.58 0 top
R29055  10K  [0201]  202.13,34.19 0 top
R29056  10K  [0201]  202.13,34.8 0 top
R29057  10K  [0201]  202.13,35.41 0 top
R29058  10K  [0201]  202.13,36.02 0 top
R29059  10K  [0201]  202.13,36.63 0 top
R29060  10K  [0201]  202.13,37.24 0 top
R29061  10K  [0201]  202.13,37.85 0 top
R29062  10K  [0201]  202.13,38.46 0 top
R29063  10K  [0201]  202.13,39.07 0 top
R29064  10K  [0201]  202.13,39.67 0 top
R29065  10K  [0201]  202.13,40.28 0 top
R29066  10K  [0201]  202.13,40.89 0 top
R29067  10K  [0201]  202.13,41.5 0 top
R29068  10K  [0201]  202.13,42.11 0 top
R29069  10K  [0201]  202.13,42.72 0 top
R29070  10K  [0201]  202.13,43.33 0 top
R29071  10K  [0201]  202.13,43.94 0 top
R29072  10K  [0201]  202.13,44.55 0 top
R29073  10K  [0201]  202.13,45.16 0 top
R29074  10K  [0201]  202.13,45.77 0 top
R29075  10K  [0201]  202.13,46.38 0 top
R29076  10K  [0201]  202.13,46.99 0 top
R29077  10K  [0201]  202.13,47.6 0 top
R29078  10K  [0201]  202.13,48.21 0 top
R29079  10K  [0201]  202.13,48.82 0 top
R29080  10K  [0201]  202.13,49.43 0 top
R29081  10K  [0201]  202.13,50.04 0 top
R29082  10K  [0201]  202.13,50.65 0 top
R29083  10K  [0201]  202.13,51.26 0 top
R29084  10K  [0201]  202.13,51.87 0 top
R29085  10K  [0201]  202.13,52.48 0 top
R29086  10K  [0201]  202.13,53.09 0 top
R29087  10K  [0201]  202.13,53.7 0 top
R29088  10K  [0201]  202.13,54.31 0 top
R29089  10K  [0201]  202.13,54.91 0 top
R29090  10K  [0201]  202.13,55.52 0 top
R29091  10K  [0201]  202.13,56.13 0 top
R29092  10K  [0201]  202.13,56.74 0 top
R29093  10K  [0201]  202.13,57.35 0 top
R29094  10K  [0201]  202.13,57.96 0 top
R29095  10K  [0201]  202.13,58.57 0 top
R29096  10K  [0201]  202.13,59.18 0 top
R29097  10K  [0201]  202.13,59.79 0 top
R29098  10K  [0201]  202.13,60.4 0 top
R29099  10K  [0201]  202.13,61.01 0 top
R29100  10K  [0201]  202.13,61.62 0 top
R29101  10K  [0201]  202.13,62.23 0 top
R29102  10K  [0201]  202.13,62.84 0 top
R29103  10K  [0201]  202.13,63.45 0 top
R29104  10K  [0201]  202.13,64.06 0 top
R29105  10K  [0201]  202.13,64.67 0 top
R29106  10K  [0201]  202.13,65.28 0 top
R29107  10K  [0201]  202.13,65.89 0 top
R29108  10K  [0201]  202.13,66.5 0 top
R29109  10K  [0201]  202.13,67.11 0 top
R29110  10K  [0201]  202.13,67.72 0 top
R29111  10K  [0201]  202.13,68.33 0 top
R29112  10K  [0201]  202.13,68.94 0 top
R29113  10K  [0201]  202.13,69.55 0 top
R29114  10K  [0201]  202.13,70.15 0 top
R29115  10K  [0201]  202.13,70.76 0 top
R29116  10K  [0201]  202.13,71.37 0 top
R29117  10K  [0201]  202.13,71.98 0 top
R29118  10K  [0201]  202.13,72.59 0 top
R29119  10K  [0201]  202.13,73.2 0 top
R29120  10K  [0201]  202.13,73.81 0 top
R29121  10K  [0201]  202.13,74.42 0 top
R29122  10K  [0201]  202.13,75.03 0 top
R29123  10K  [0201]  202.13,75.64 0 top
R29124  10K  [0201]  202.13,76.25 0 top
R29125  10K  [0201]  202.13,76.86 0 top
R29126  10K  [0201]  202.13,77.47 0 top
R29127  10K  [0201]  202.13,78.08 0 top
R29128  10K  [0201]  202.13,78.69 0 top
R29129  10K  [0201]  202.13,79.3 0 top
R29130  10K  [0201]  202.13,79.91 0 top
R29131  10K  [0201]  202.13,80.52 0 top
R29132  10K  [0201]  202.13,81.13 0 top
R29133  10K  [0201]  202.13,81.74 0 top
R29134  10K  [0201]  202.13,82.35 0 top
R29135  10K  [0201]  202.13,82.96 0 top
R29136  10K  [0201]  202.13,83.57 0 top
R29137  10K  [0201]  202.13,84.18 0 top
R29138  10K  [0201]  202.13,84.79 0 top
R29139  10K  [0201]  202.13,85.39 0 top
R29140  10K  [0201]  202.13,86 0 top
R29141  10K  [0201]  202.13,86.61 0 top
R29142  10K  [0201]  202.13,87.22 0 top
R29143  10K  [0201]  202.13,87.83 0 top
R29144  10K  [0201]  202.13,88.44 0 top
R29145  10K  [0201]  202.13,89.05 0 top
R29146  10K  [0201]  202.13,89.66 0 top
R29147  10K  [0201]  202.13,90.27 0 top
R29148  10K  [0201]  202.13,90.88 0 top
R29149  10K  [0201]  202.13,91.49 0 top
R29150  10K  [0201]  202.13,92.1 0 top
R29151  10K  [0201]  202.13,92.71 0 top
R29152  10K  [0201]  202.13,93.32 0 top
R29153  10K  [0201]  202.13,93.93 0 top
R29154  10K  [0201]  202.13,94.54 0 top
R29155  10K  [0201]  202.13,95.15 0 top
R29156  10K  [0201]  202.13,95.76 0 top
R29157  10K  [0201]  202.13,96.37 0 top
R29158  10K  [0201]  202.13,96.98 0 top
R29159  10K  [0201]  202.13,97.59 0 top
R29160  10K  [0201]  202.13,98.2 0 top
R29161  10K  [0201]  202.13,98.81 0 top
R29162  10K  [0201]  202.13,99.42 0 top
R29163  10K  [0201]  202.13,100.03 0 top
R29164  10K  [0201]  202.13,100.63 0 top
R29165  10K  [0201]  202.13,101.24 0 top
R29166  10K  [0201]  202.13,101.85 0 top
R29167  10K  [0201]  202.13,102.46 0 top
R29168  10K  [0201]  202.13,103.07 0 top
R29169  10K  [0201]  202.13,103.68 0 top
R29170  10K  [0201]  202.13,104.29 0 top
R29171  10K  [0201]  202.13,104.9 0 top
R29172  10K  [0201]  202.13,105.51 0 top
R29173  10K  [0201]  202.13,106.12 0 top
R29174  10K  [0201]  202.13,106.73 0 top
R29175  10K  [0201]  202.13,107.34 0 top
R29176  10K  [0201]  202.13,107.95 0 top
R29177  10K  [0201]  202.13,108.56 0 top
R29178  10K  [0201]  202.13,109.17 0 top
R29179  10K  [0201]  202.13,109.78 0 top
R29180  10K  [0201]  202.13,110.39 0 top
R29181  10K  [0201]  202.13,111 0 top
R29182  10K  [0201]  202.13,111.61 0 top
R29183  10K  [0201]  202.13,112.22 0 top
R29184  10K  [0201]  202.13,112.83 0 top
R29185  10K  [0201]  202.13,113.44 0 top
R29186  10K  [0201]  202.13,114.05 0 top
R29187  10K  [0201]  202.13,114.66 0 top
R29188  10K  [0201]  202.13,115.27 0 top
R29189  10K  [0201]  202.13,115.87 0 top
R29190  10K  [0201]  202.13,116.48 0 top
R29191  10K  [0201]  202.13,117.09 0 top
R29192  10K  [0201]  202.13,117.7 0 top
R29193  10K  [0201]  202.13,118.31 0 top
R29194  10K  [0201]  202.13,118.92 0 top
R29195  10K  [0201]  202.13,119.53 0 top
R29196  10K  [0201]  202.13,120.14 0 top
R29197  10K  [0201]  202.13,120.75 0 top
R29198  10K  [0201]  202.13,121.36 0 top
R29199  10K  [0201]  202.13,121.97 0 top
R29200  10K  [0201]  202.13,122.58 0 top
R29201  10K  [0201]  203.35,1.27 0 top
R29202  10K  [0201]  203.35,1.88 0 top
R29203  10K  [0201]  203.35,2.49 0 top
R29204  10K  [0201]  203.35,3.1 0 top
R29205  10K  [0201]  203.35,3.71 0 top
R29206  10K  [0201]  203.35,4.32 0 top
R29207  10K  [0201]  203.35,4.93 0 top
R29208  10K  [0201]  203.35,5.54 0 top
R29209  10K  [0201]  203.35,6.15 0 top
R29210  10K  [0201]  203.35,6.76 0 top
R29211  10K  [0201]  203.35,7.37 0 top